# EasyEDA Pro project wukong01-Y003-HTOL.eprj, board PCB1 (continued)
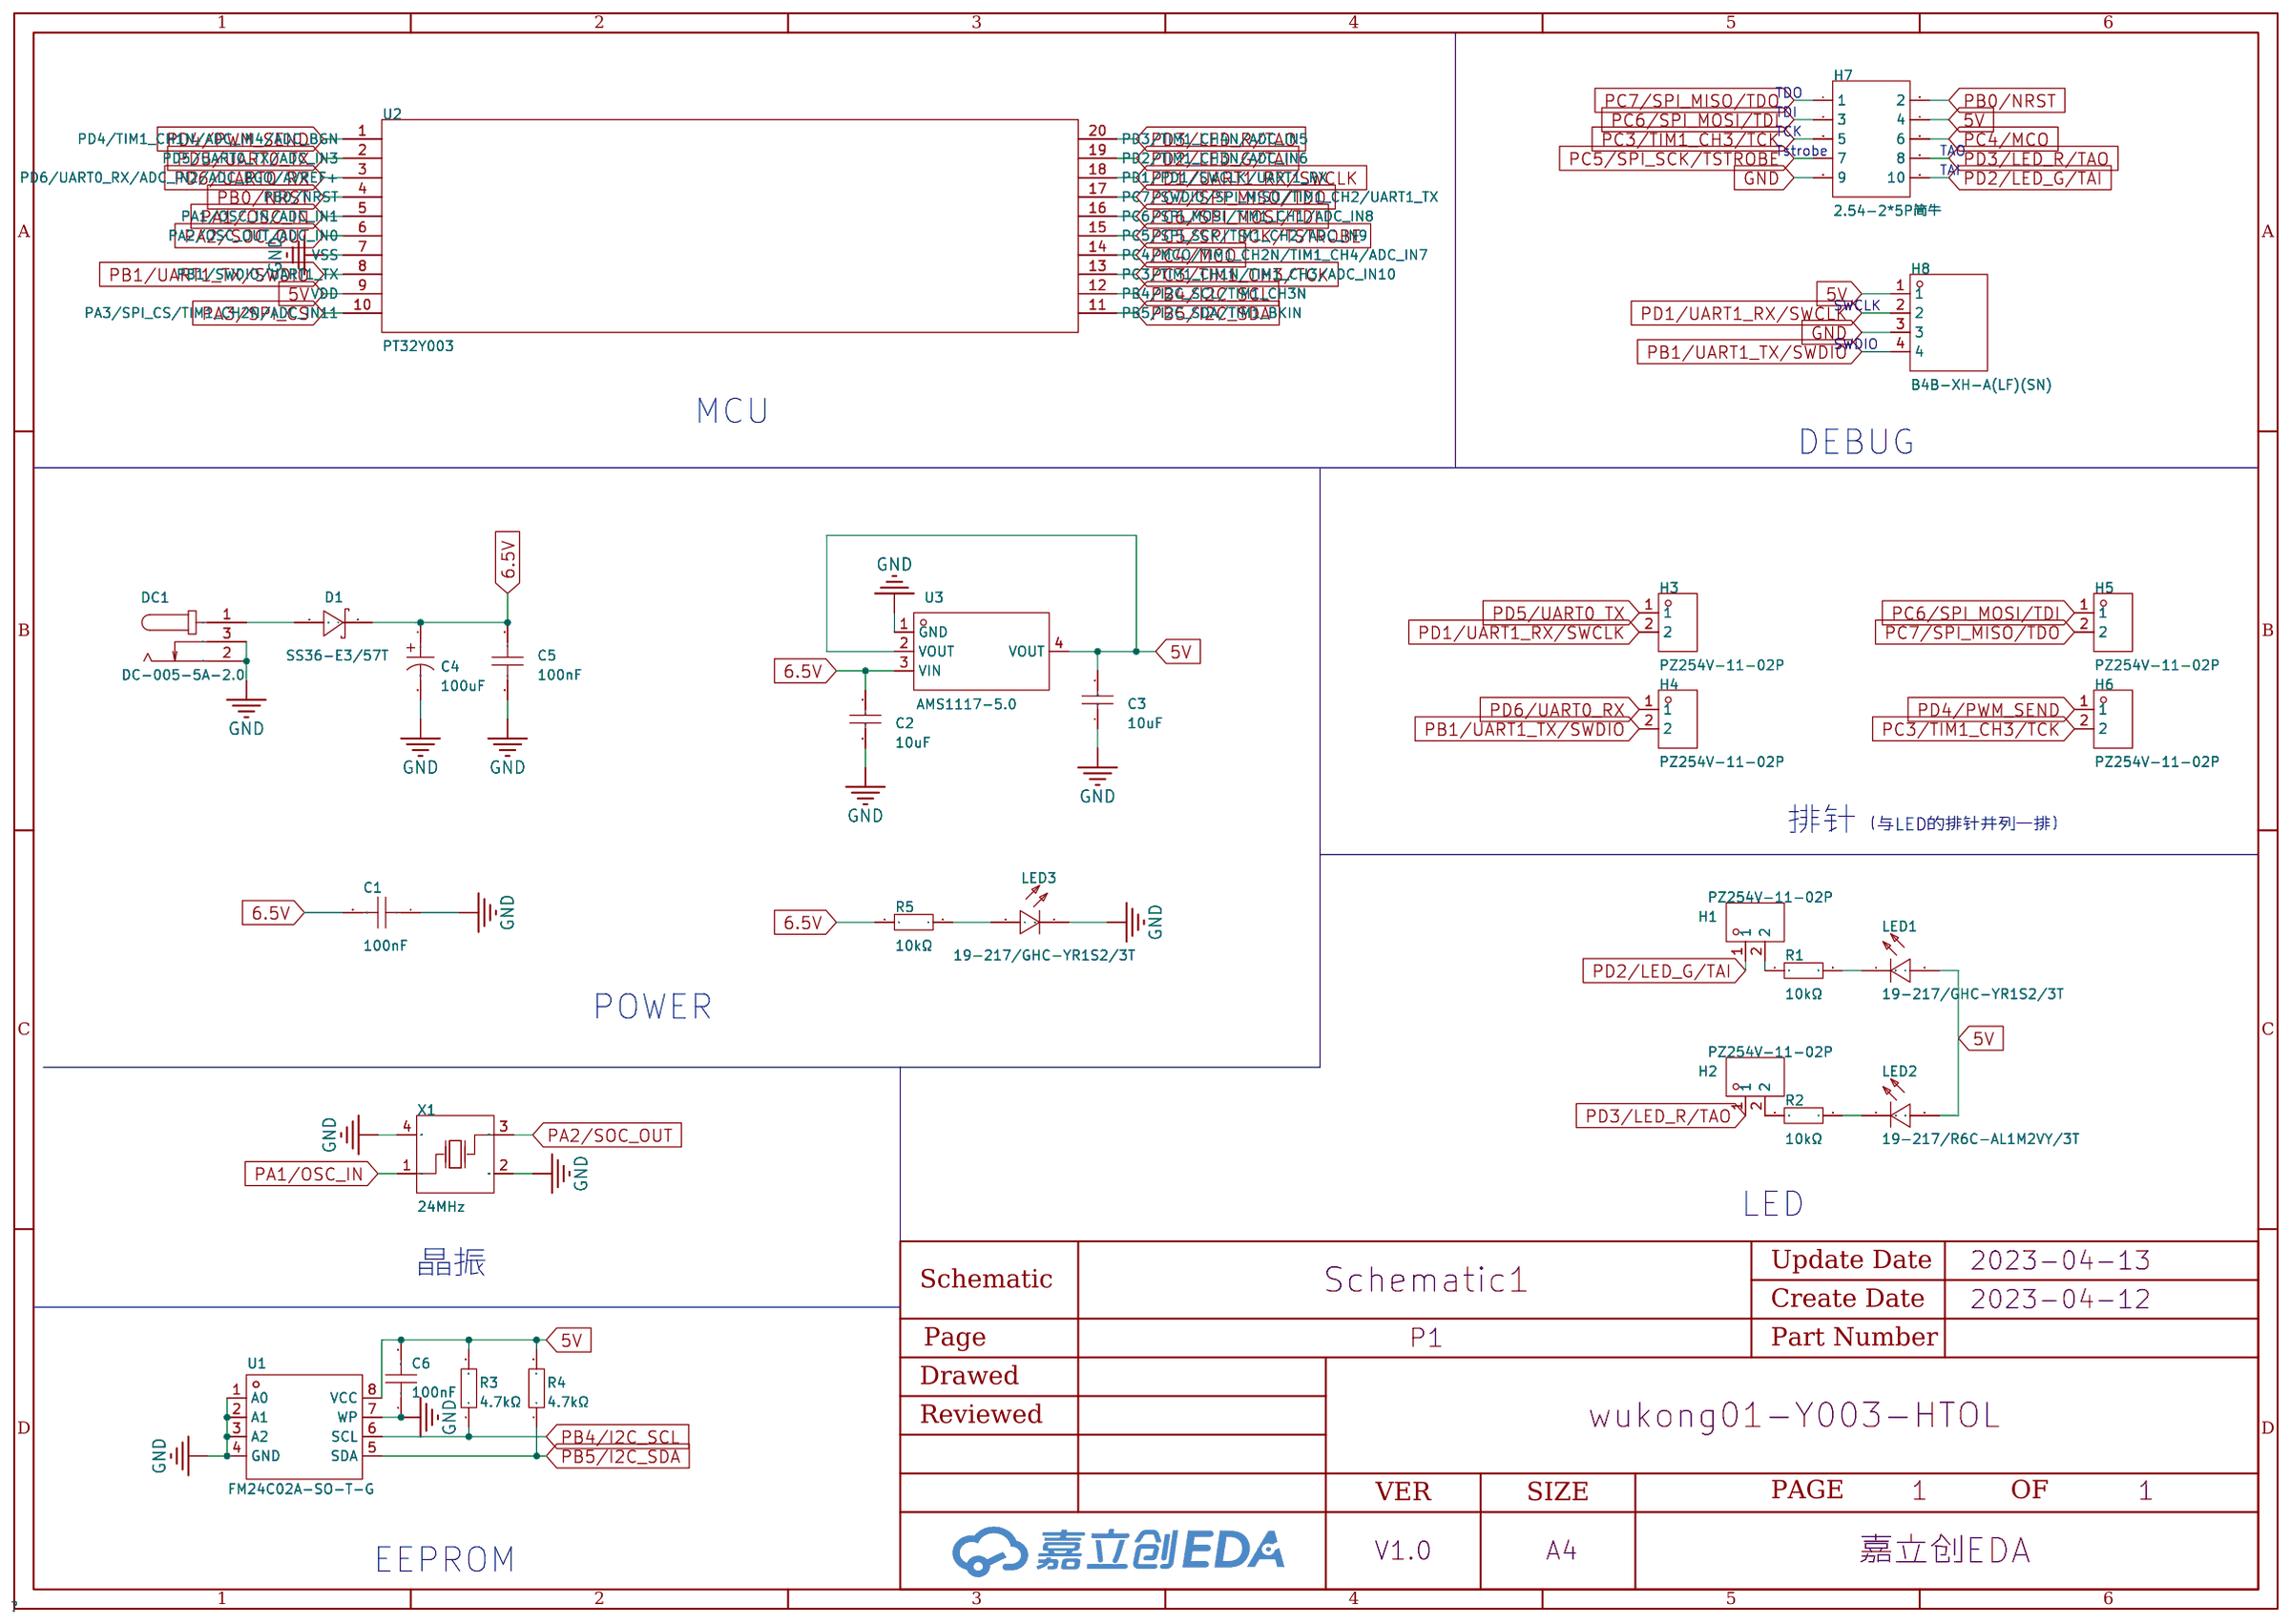
[diagram p0: schematic sheet]
## Routing (per net, layer and track width the routed paths; a pad name or vN(x,y) marks a point on that pad's centre or on a via; arc(x,y) is an arc through that point) (continued)
  Bottom Layer w0.5: v1(257.43,123.7) v1(253.37,123.7) ; H8#7.1 74.3,289.81 76.2,287.91 ; 223.27,244.98 221.36,246.89 H8#27.1 ; v1(208.41,209.55) v1(204.34,209.55) ; 27.18,202.06 25.27,203.96 H8#34.1 ; v1(61.34,80.77) v1(57.28,80.77) ; v1(110.36,209.55) v1(106.3,209.55) ; 223.27,116.21 221.36,118.11 H8#5.1 ; v1(268.85,267.72) v1(268.85,271.02) ; v1(72.76,267.72) v1(72.76,271.02) ; v1(61.34,166.62) v1(57.28,166.62) ; v1(121.78,53.09) v1(121.78,56.39) ; v1(219.83,53.09) v1(219.83,56.39) ; H8#14.1 270.38,75.18 H7#13.4 ; 27.18,159.13 25.27,161.04 H8#40.1 ; H7#32.4 270.38,203.96 H8#32.1 ; v1(72.76,96.01) v1(72.76,99.31) ; 27.18,244.98 25.27,246.89 H8#28.1 ; 223.27,159.13 221.36,161.04 H8#39.1 ; v1(121.78,138.94) v1(121.78,142.24) ; v1(208.41,295.4) v1(204.34,295.4) ; v1(268.85,138.94) v1(268.85,142.24) ; v1(61.34,123.7) v1(57.28,123.7) ; v1(170.81,53.09) v1(170.81,56.39) ; v1(72.76,224.79) v1(72.76,228.09) ; v1(219.83,138.94) v1(219.83,142.24) ; H8#33.1 221.36,203.96 223.27,202.06 ; H7#16.4 172.34,75.18 H8#13.1 ; v1(208.41,123.7) v1(204.34,123.7) ; v1(170.81,138.94) v1(170.81,142.24) ; v1(219.83,96.01) v1(219.83,99.31) ; v1(257.43,252.48) v1(253.37,252.48) ; H8.1 74.3,118.11 76.2,116.21 ; H8#9.1 123.32,289.81 H7#9.4 ; v1(61.34,37.85) v1(57.28,37.85) ; v1(12.32,123.7) v1(8.26,123.7) ; H8#11.1 25.27,75.18 27.18,73.28 ; 27.18,30.35 25.27,32.26 H8#17.1 ; 223.27,287.91 221.36,289.81 H8#15.1 ; 76.2,244.98 74.3,246.89 H8#23.1 ; 76.2,30.35 74.3,32.26 H8#16.1 ; v1(208.41,37.85) v1(204.34,37.85) ; v1(72.76,10.16) v1(72.76,13.46) ; v1(110.36,123.7) v1(106.3,123.7) ; H7#35.4 123.32,161.04 H8#37.1 ; v1(23.74,53.09) v1(23.74,56.39) ; v1(110.36,166.62) v1(106.3,166.62) ; v1(170.81,181.86) v1(170.81,185.17) ; H7.4 123.32,118.11 H8#3.1 ; v1(72.76,181.86) v1(72.76,185.17) ; H8#20.1 123.32,32.26 H7#20.4 ; v1(170.81,96.01) v1(170.81,99.31) ; H7#17.4 123.32,75.18 H8#18.1 ; H8#4.1 270.38,118.11 H7#4.4 ; v1(110.36,252.48) v1(106.3,252.48) ; H8#12.1 74.3,75.18 76.2,73.28 ; H7#25.4 172.34,246.89 H8#24.1 ; 76.2,159.13 74.3,161.04 H8#35.1 ; H8#2.1 172.34,118.11 H7#3.4 ; v1(257.43,80.77) v1(253.37,80.77) ; H8#36.1 172.34,161.04 H7#37.4 ; 223.27,73.28 221.36,75.18 H8#22.1 ; H8#21.1 221.36,32.26 223.27,30.35 ; H8#25.1 123.32,246.89 H7#23.4 ; v1(110.36,295.4) v1(106.3,295.4) ; H8#26.1 270.38,246.89 H7#26.4 ; v1(72.76,53.09) v1(72.76,56.39) ; v1(121.78,96.01) v1(121.78,99.31) ; H8#19.1 172.34,32.26 H7#21.4 ; H7#31.4 172.34,203.96 H8#30.1 ; H8#10.1 270.38,289.81 H7#10.4 ; H7#29.4 123.32,203.96 H8#31.1 ; v1(61.34,295.4) v1(57.28,295.4) ; v1(12.32,80.77) v1(8.26,80.77) ; v1(159.38,252.48) v1(155.32,252.48) ; v1(268.85,181.86) v1(268.85,185.17) ; v1(159.38,80.77) v1(155.32,80.77) ; v1(12.32,166.62) v1(8.26,166.62) ; v1(159.38,295.4) v1(155.32,295.4) ; H8#29.1 74.3,203.96 76.2,202.06 ; v1(268.85,53.09) v1(268.85,56.39) ; v1(219.83,10.16) v1(219.83,13.46) ; v1(121.78,181.86) v1(121.78,185.17) ; v1(23.74,10.16) v1(23.74,13.46) ; v1(208.41,166.62) v1(204.34,166.62) ; v1(170.81,10.16) v1(170.81,13.46) ; v1(23.74,96.01) v1(23.74,99.31) ; v1(268.85,224.79) v1(268.85,228.09) ; v1(208.41,252.48) v1(204.34,252.48) ; H8#6.1 25.27,118.11 27.18,116.21 ; v1(61.34,252.48) v1(57.28,252.48) ; v1(219.83,181.86) v1(219.83,185.17) ; v1(12.32,209.55) v1(8.26,209.55) ; v1(268.85,96.01) v1(268.85,99.31) ; v1(170.81,267.72) v1(170.81,271.02) ; v1(170.81,224.79) v1(170.81,228.09) ; v1(23.74,138.94) v1(23.74,142.24) ; v1(23.74,224.79) v1(23.74,228.09) ; H7#38.4 270.38,161.04 H8#38.1 ; v1(257.43,166.62) v1(253.37,166.62) ; v1(72.76,138.94) v1(72.76,142.24) ; v1(159.38,123.7) v1(155.32,123.7) ; v1(257.43,295.4) v1(253.37,295.4) ; v1(159.38,209.55) v1(155.32,209.55) ; v1(219.83,267.72) v1(219.83,271.02) ; H7#8.4 172.34,289.81 H8#8.1 ; v1(121.78,267.72) v1(121.78,271.02) ; v1(159.38,37.85) v1(155.32,37.85) ; v1(257.43,209.55) v1(253.37,209.55) ; v1(159.38,166.62) v1(155.32,166.62) ; v1(121.78,10.16) v1(121.78,13.46) ; v1(12.32,37.85) v1(8.26,37.85) ; v1(23.74,181.86) v1(23.74,185.17) ; v1(219.83,224.79) v1(219.83,228.09) ; v1(61.34,209.55) v1(57.28,209.55) ; v1(110.36,80.77) v1(106.3,80.77) ; v1(208.41,80.77) v1(204.34,80.77) ; v1(110.36,37.85) v1(106.3,37.85) ; v1(12.32,252.48) v1(8.26,252.48) ; v1(121.78,224.79) v1(121.78,228.09)
6.5V: length 74.3
  Top Layer w0.5: C4.1 19.69,283.85 D1.2 39.67,289.43 U3#4.3 39.81,281.44 35.63,277.25 ; 21.59,274.87 19.77,274.87 17.53,277.11 9,277.11 8.62,276.73 8.62,274.89 ; 21.59,274.87 U3#2.3 ; 21.59,274.87 21.59,276.61 22.24,277.25 35.63,277.25 ; 35.63,277.25 34.76,276.38 U3#3.3
GND: length 6472
  Top Layer w0.4: X1#40.2 159.7,154.65 ; X1#5.2 12.64,111.72 ; X1#29.2 208.72,197.57 ; X1#28.2 159.7,240.5 ; 112.38,24.17 X1#13.4 ; 112.38,110.02 X1#3.4 ; X1#2.2 61.66,111.72 ; X1#39.2 12.64,154.65 ; 14.34,195.87 X1#33.4 ; 210.42,24.17 X1#20.4 ; X1#15.2 159.7,68.8 ; 63.36,152.95 X1#36.4 ; 14.34,152.95 X1#39.4 ; 161.4,110.02 X1#6.4 ; X1#22.2 12.64,25.87 ; X1#33.2 12.64,197.57 ; 259.44,152.95 X1#38.4 ; X1#20.2 208.72,25.87 ; 63.36,24.17 X1#14.4 ; X1#26.2 257.75,240.5 ; 210.42,281.73 X1#12.4 ; 14.34,24.17 X1#22.4 ; 259.44,67.09 259.55,67.09 ; X1#10.2 61.66,68.8 ; X1#8.2 159.7,283.43 ; X1#4.2 257.75,111.72 ; 112.38,152.95 X1#37.4 ; 161.4,152.95 X1#40.4 ; 210.42,152.95 X1#35.4 ; 112.38,238.8 X1#25.4 ; X1#27.2 12.64,240.5 ; 161.4,67.09 161.5,67.09 ; X1#3.2 110.68,111.72 ; X1#31.2 110.68,197.57 ; 259.44,110.02 X1#4.4 ; 259.44,238.8 X1#26.4 ; X1#16.2 257.75,68.8 ; 14.34,238.8 X1#27.4 ; 210.42,195.87 X1#29.4 ; 161.4,24.17 X1#21.4 ; X1#24.2 61.66,240.5 ; X1#30.2 61.66,197.57 ; X1#12.2 208.72,283.43 ; 63.36,281.73 X1#7.4 ; 112.38,195.87 X1#31.4 ; 63.36,195.87 X1#30.4 ; X1#18.2 110.68,68.8 ; X1#37.2 110.68,154.65 ; X1#17.2 12.64,68.8 ; X1#34.2 159.7,197.57 ; 63.36,238.8 X1#24.4 ; 210.42,238.8 X1#23.4 ; X1#9.2 110.68,283.43 ; 161.4,195.87 X1#34.4 ; X1#23.2 208.72,240.5 ; 63.36,110.02 X1#2.4 ; X1.2 208.72,111.72 ; 112.38,67.09 112.48,67.09 ; 259.44,195.87 X1#32.4 ; 63.36,67.09 63.46,67.09 ; X1#19.2 208.72,68.8 ; 161.4,238.8 X1#28.4 ; 210.42,67.09 210.52,67.09 ; X1#14.2 61.66,25.87 ; X1#13.2 110.68,25.87 ; X1#35.2 208.72,154.65 ; X1#21.2 159.7,25.87 ; 210.42,110.02 X1.4 ; 259.44,281.73 X1#11.4 ; 161.4,281.73 X1#8.4 ; X1#25.2 110.68,240.5 ; X1#7.2 61.66,283.43 ; 14.34,67.09 14.44,67.09 ; X1#32.2 257.75,197.57 ; X1#36.2 61.66,154.65 ; 14.34,110.02 X1#5.4 ; X1#11.2 257.75,283.43 ; 112.38,281.73 X1#9.4 ; X1#38.2 257.75,154.65 ; X1#6.2 159.7,111.72
  Top Layer w0.5: 157.37,56.26 U1#17.3 U1#17.4 ; 157.37,56.26 157.5,56.39 U1#17.7 C6#21.1 ; 157.37,56.26 U1#17.2 157.37,57.53 157.35,57.55 157.35,58.97 ; H7#23.9 132.97,242.32 v1(134.75,242.32) ; 108.33,154.65 108.33,168.52 v1(108.34,168.53) 127.51,168.53 128.4,167.64 H8#37.3 ; 108.33,154.65 X1#37.2 ; 108.33,154.65 108.33,144.82 ; v1(134.75,285.24) 132.97,285.24 H7#9.9 ; 255.42,270.89 U1#10.2 255.42,272.16 255.4,272.18 255.4,273.6 ; 255.42,270.89 U1#10.3 U1#10.4 ; 255.42,270.89 255.54,271.02 C6#11.1 ; 108.33,240.5 108.33,254.37 v1(108.34,254.38) 127.51,254.38 128.4,253.49 H8#25.3 ; 108.33,240.5 108.33,230.67 ; 108.33,240.5 X1#25.2 ; U1#11.4 U1#11.3 59.33,56.26 ; v1(134.75,113.54) 132.97,113.54 132.84,113.67 ; 206.38,154.65 206.38,144.82 ; 206.38,154.65 206.38,168.52 v1(206.39,168.53) 225.55,168.53 226.44,167.64 H8#39.3 ; 206.38,154.65 X1#35.2 ; 206.38,144.82 206.38,143.4 206.4,143.38 U1#38.2 206.4,142.11 ; 206.38,144.82 U2#38.7 ; U2#29.7 10.29,230.67 ; 10.29,230.67 10.29,240.5 ; 10.29,230.67 10.29,229.26 10.31,229.24 U1#27.2 10.31,227.97 ; 28.17,278.51 24.88,278.51 ; 28.17,278.51 31.47,278.51 ; 28.17,278.51 28.2,278.54 LED3.1 ; 24.88,278.51 19.69,278.51 C4.2 19.68,278.51 9.14,278.51 8.06,279.59 DC1.3 9.77,298.07 DC1.2 14.78,301.07 21.84,294 39.7,294 U3#4.1 40.88,294.96 C3#4.1 51.18,298.83 v1(54.1,301.75) ; 24.88,278.51 24.89,278.52 C2.2 ; X1#34.2 157.35,197.57 ; 157.35,197.57 157.35,211.44 v1(157.37,211.46) 176.53,211.46 177.42,210.57 H8#30.3 ; 157.35,197.57 157.35,187.75 ; 206.38,25.87 206.38,39.74 v1(206.39,39.75) 225.55,39.75 226.44,38.86 H8#21.3 ; 206.38,25.87 206.38,16.04 ; 206.38,25.87 X1#20.2 ; 59.31,144.82 59.31,143.4 59.33,143.38 U1#35.2 59.33,142.11 ; 59.31,144.82 59.31,154.65 ; 59.31,144.82 U2#39.7 ; U1#14.4 U1#14.3 255.42,56.26 ; 108.33,197.57 108.33,211.44 v1(108.34,211.46) 127.51,211.46 128.4,210.57 H8#31.3 ; 108.33,197.57 X1#31.2 ; 108.33,197.57 108.33,187.75 ; 10.31,13.34 10.44,13.46 U1#12.7 C6#17.1 ; 10.31,13.34 U1#12.3 U1#12.4 ; 10.31,13.34 U1#12.2 10.31,14.61 10.29,14.63 10.29,16.04 ; 108.35,142.11 108.35,143.38 108.33,143.4 108.33,144.82 ; 108.35,142.11 108.35,139.7 ; 108.35,142.11 108.48,142.24 U1#37.7 C6#36.1 ; 108.35,270.89 108.35,268.48 ; 108.35,270.89 108.48,271.02 U1#9.7 C6#10.1 ; 108.35,270.89 108.35,272.16 108.33,272.18 108.33,273.6 ; 83.82,27.81 83.95,27.69 v1(85.72,27.69) ; 206.4,142.11 206.52,142.24 U1#38.7 C6#40.1 ; 206.4,142.11 U1#38.3 U1#38.4 ; 255.4,273.6 U2#13.7 ; 255.4,273.6 255.4,283.43 ; U1#30.4 U1#30.3 255.42,185.04 ; 255.4,187.75 255.4,186.33 255.42,186.31 U1#30.2 255.42,185.04 ; 255.4,187.75 U2#31.7 ; 255.4,187.75 255.4,197.57 ; 59.31,187.75 59.31,186.33 59.33,186.31 U1#29.2 59.33,185.04 ; 59.31,187.75 U2#33.7 ; 59.31,187.75 59.31,197.57 ; X1#15.2 157.35,68.8 ; 157.35,68.8 157.35,58.97 ; 157.35,68.8 157.35,82.67 v1(157.37,82.68) 176.53,82.68 177.42,81.79 H8#13.3 ; 108.33,16.04 108.33,14.63 108.35,14.61 108.35,13.34 ; 108.33,16.04 108.33,25.87 ; 108.33,16.04 U2#18.7 ; 230.89,156.59 231.01,156.46 v1(232.79,156.46) ; v1(232.79,70.61) 231.01,70.61 230.89,70.74 ; H7#8.9 181.99,285.24 v1(183.77,285.24) ; 108.33,273.6 U2#11.7 ; 108.33,273.6 108.33,283.43 ; v1(281.81,242.32) 280.04,242.32 H7#26.9 ; 10.31,99.19 U1#5.3 U1#5.4 ; 10.31,99.19 U1#5.2 10.31,100.46 10.29,100.48 10.29,101.9 ; 10.31,99.19 10.44,99.31 U1#5.7 C6#7.1 ; H8#36.3 177.42,167.64 176.53,168.53 v1(157.37,168.53) 157.35,168.52 157.35,154.65 ; 108.35,99.19 108.35,96.77 ; 108.35,99.19 108.35,100.46 108.33,100.48 108.33,101.9 ; 108.35,99.19 108.48,99.31 U1#3.7 C6#2.1 ; 59.31,25.87 59.31,16.04 ; 59.31,25.87 59.31,39.74 v1(59.32,39.75) 78.49,39.75 79.38,38.86 H8#16.3 ; 59.31,25.87 X1#14.2 ; 59.31,16.04 U2#23.7 ; 59.31,16.04 59.31,14.63 59.33,14.61 U1#16.2 59.33,13.34 ; 157.35,230.67 157.35,229.26 157.37,229.24 U1#28.2 157.37,227.97 ; 157.35,230.67 U2#28.7 ; 157.35,230.67 157.35,240.5 ; 10.31,185.04 U1#33.2 10.31,186.31 10.29,186.33 10.29,187.75 ; 10.31,185.04 U1#33.3 U1#33.4 ; 10.31,185.04 10.44,185.17 U1#33.7 C6#35.1 ; v1(36.7,70.61) 34.92,70.61 34.8,70.74 ; 10.31,227.97 U1#27.3 U1#27.4 ; 10.31,227.97 10.44,228.09 U1#27.7 C6#29.1 ; 255.42,142.11 U1#36.2 255.42,143.38 255.4,143.4 255.4,144.82 ; 255.42,142.11 255.54,142.24 C6#39.1 ; 255.42,142.11 U1#36.3 U1#36.4 ; 255.4,101.9 255.4,100.48 255.42,100.46 U1#2.2 255.42,99.19 ; 255.4,101.9 U2#3.7 ; 255.4,101.9 255.4,111.72 ; v1(183.77,27.69) 181.99,27.69 181.86,27.81 ; 10.29,111.72 10.29,125.59 v1(10.3,125.6) 29.46,125.6 30.35,124.71 H8#6.3 ; 10.29,111.72 X1#5.2 ; 10.29,111.72 10.29,101.9 ; 255.42,56.26 255.54,56.39 C6#15.1 ; 255.42,56.26 U1#14.2 255.42,57.53 255.4,57.55 255.4,58.97 ; U1#16.4 U1#16.3 59.33,13.34 ; 157.37,13.34 U1#20.3 U1#20.4 ; 157.37,13.34 U1#20.2 157.37,14.61 157.35,14.63 157.35,16.04 ; 157.37,13.34 157.5,13.46 U1#20.7 C6#19.1 ; 230.89,242.44 231.01,242.32 v1(232.79,242.32) ; 157.35,240.5 157.35,254.37 v1(157.37,254.38) 176.53,254.38 177.42,253.49 H8#24.3 ; 157.35,240.5 X1#28.2 ; U1#6.4 U1#6.3 157.37,99.19 ; 10.29,240.5 10.29,254.37 v1(10.3,254.38) 29.46,254.38 30.35,253.49 H8#28.3 ; 10.29,240.5 X1#27.2 ; X1#3.2 108.33,111.72 ; 108.33,111.72 108.33,101.9 ; 108.33,111.72 108.33,125.59 v1(108.34,125.6) 127.51,125.6 128.4,124.71 H8#3.3 ; 157.35,25.87 157.35,39.74 v1(157.37,39.75) 176.53,39.75 177.42,38.86 H8#19.3 ; 157.35,25.87 157.35,16.04 ; 157.35,25.87 X1#21.2 ; U1#34.4 U1#34.3 157.37,185.04 ; C6#20.1 U1#16.7 59.46,13.46 59.33,13.34 ; 279.91,156.59 280.04,156.46 v1(281.81,156.46) ; 157.37,227.97 157.5,228.09 U1#28.7 C6#26.1 ; 157.37,227.97 U1#28.3 U1#28.4 ; 157.37,270.89 U1#8.3 U1#8.4 ; 157.37,270.89 157.5,271.02 U1#8.7 C6#9.1 ; 157.37,270.89 U1#8.2 157.37,272.16 157.35,272.18 157.35,273.6 ; 230.89,199.52 231.01,199.39 v1(232.79,199.39) ; X1#17.2 10.29,68.8 ; 10.29,68.8 10.29,82.67 v1(10.3,82.68) 29.46,82.68 30.35,81.79 H8#11.3 ; 10.29,68.8 10.29,58.97 ; 108.35,185.04 108.48,185.17 U1#31.7 C6#30.1 ; 108.35,185.04 108.35,182.63 ; 108.35,185.04 108.35,186.31 108.33,186.33 108.33,187.75 ; 10.31,56.26 U1#22.2 10.31,57.53 10.29,57.55 10.29,58.97 ; 10.31,56.26 U1#22.3 U1#22.4 ; 10.31,56.26 10.44,56.39 U1#22.7 C6#16.1 ; 108.35,13.34 108.35,10.92 ; 108.35,13.34 108.48,13.46 U1#21.7 C6#14.1 ; 206.38,16.04 206.38,14.63 206.4,14.61 U1#19.2 206.4,13.34 ; 206.38,16.04 U2#21.7 ; v1(85.72,70.61) 83.95,70.61 H7#15.9 ; C6#37.1 U1#35.7 59.46,142.24 59.33,142.11 ; 157.35,154.65 157.35,144.82 ; 157.35,154.65 X1#40.2 ; C6#4.1 U1#6.7 157.5,99.31 157.37,99.19 ; U1#24.4 U1#24.3 255.42,227.97 ; v1(134.75,156.46) 132.97,156.46 132.84,156.59 ; 59.33,270.89 U1#7.3 U1#7.4 ; 59.33,270.89 59.46,271.02 U1#7.7 C6#8.1 ; 59.33,270.89 U1#7.2 59.33,272.16 59.31,272.18 59.31,273.6 ; v1(281.81,70.61) 280.04,70.61 H7#13.9 ; v1(281.81,199.39) 280.04,199.39 H7#32.9 ; v1(183.77,242.32) 181.99,242.32 H7#25.9 ; X1#33.2 10.29,197.57 ; 10.29,197.57 10.29,211.44 v1(10.3,211.46) 29.46,211.46 30.35,210.57 H8#34.3 ; 10.29,197.57 10.29,187.75 ; X1#10.2 59.31,68.8 ; 59.31,68.8 59.31,82.67 v1(59.32,82.68) 78.49,82.68 79.38,81.79 H8#12.3 ; 59.31,68.8 59.31,58.97 ; 255.42,227.97 255.54,228.09 C6#27.1 ; 255.42,227.97 U1#24.2 255.42,229.24 255.4,229.26 255.4,230.67 ; 10.29,144.82 10.29,143.4 10.31,143.38 U1#39.2 10.31,142.11 ; 10.29,144.82 U2.7 ; 10.29,144.82 10.29,154.65 ; U1#4.4 U1#4.3 206.4,99.19 ; H8#20.3 128.4,38.86 127.51,39.75 v1(108.34,39.75) 108.33,39.74 108.33,25.87 ; 230.89,285.37 231.01,285.24 v1(232.79,285.24) ; 206.38,58.97 206.38,57.55 206.4,57.53 U1#15.2 206.4,56.26 ; 206.38,58.97 U2#19.7 ; 206.38,58.97 206.38,68.8 ; U2#12.7 255.4,58.97 ; 255.4,58.97 255.4,68.8 ; 108.33,68.8 108.33,58.97 ; 108.33,68.8 X1#18.2 ; 108.33,68.8 108.33,82.67 v1(108.34,82.68) 127.51,82.68 128.4,81.79 H8#18.3 ; 108.33,58.97 U2#15.7 ; 108.33,58.97 108.33,57.55 108.35,57.53 108.35,56.26 ; v1(183.77,199.39) 181.99,199.39 H7#31.9 ; C6#23.1 U1#15.7 206.52,56.39 206.4,56.26 ; 34.8,242.44 34.92,242.32 v1(36.7,242.32) ; U1#19.4 U1#19.3 206.4,13.34 ; 157.35,58.97 U2#7.7 ; 59.31,154.65 59.31,168.52 v1(59.32,168.53) 78.49,168.53 79.38,167.64 H8#35.3 ; 59.31,154.65 X1#36.2 ; 255.42,99.19 U1#2.3 U1#2.4 ; 255.42,99.19 255.54,99.31 C6#5.1 ; X1#13.2 108.33,25.87 ; 108.33,187.75 U2#30.7 ; 206.4,99.19 U1#4.2 206.4,100.46 206.38,100.48 206.38,101.9 ; 206.4,99.19 206.52,99.31 U1#4.7 C6#6.1 ; v1(36.7,113.54) 34.92,113.54 34.8,113.67 ; 59.33,99.19 59.46,99.31 U1.7 C6#3.1 ; 59.33,99.19 U1.3 U1.4 ; 59.33,99.19 U1.2 59.33,100.46 59.31,100.48 59.31,101.9 ; U1#29.4 U1#29.3 59.33,185.04 ; H8#2.3 177.42,124.71 176.53,125.6 v1(157.37,125.6) 157.35,125.59 157.35,111.72 ; U2#32.7 206.38,187.75 ; 206.38,187.75 206.38,197.57 ; 206.38,187.75 206.38,186.33 206.4,186.31 U1#32.2 206.4,185.04 ; 206.4,270.89 U1#13.2 206.4,272.16 206.38,272.18 206.38,273.6 ; 206.4,270.89 U1#13.3 U1#13.4 ; 206.4,270.89 206.52,271.02 U1#13.7 C6#12.1 ; v1(281.81,113.54) 280.04,113.54 279.91,113.67 ; X1#23.2 206.38,240.5 ; 206.38,240.5 206.38,230.67 ; 206.38,240.5 206.38,254.37 v1(206.39,254.38) 225.55,254.38 226.44,253.49 H8#27.3 ; C6#38.1 U1#40.7 157.5,142.24 157.37,142.11 ; v1(36.7,27.69) 34.92,27.69 34.8,27.81 ; 10.31,142.11 U1#39.3 U1#39.4 ; 10.31,142.11 10.44,142.24 U1#39.7 C6.1 ; 206.38,111.72 206.38,101.9 ; 206.38,111.72 206.38,125.59 v1(206.39,125.6) 225.55,125.6 226.44,124.71 H8#5.3 ; 206.38,111.72 X1.2 ; 206.38,101.9 U2#4.7 ; 206.4,13.34 206.52,13.46 U1#19.7 C6#22.1 ; H7#30.9 83.95,199.39 v1(85.72,199.39) ; 10.29,101.9 U2#8.7 ; 108.35,56.26 108.35,53.85 ; 108.35,56.26 108.48,56.39 U1#18.7 C6#13.1 ; X1#4.2 255.4,111.72 ; 255.4,111.72 255.4,125.59 v1(255.41,125.6) 274.57,125.6 275.46,124.71 H8#4.3 ; 157.35,144.82 157.35,143.4 157.37,143.38 U1#40.2 157.37,142.11 ; 157.35,144.82 U2#40.7 ; 255.4,68.8 255.4,82.67 v1(255.41,82.68) 274.57,82.68 275.46,81.79 H8#14.3 ; 255.4,68.8 X1#16.2 ; H7#10.9 280.04,285.24 v1(281.81,285.24) ; 255.42,185.04 255.54,185.17 C6#33.1 ; C6#31.1 U1#29.7 59.46,185.17 59.33,185.04 ; 206.38,68.8 206.38,82.67 v1(206.39,82.68) 225.55,82.68 226.44,81.79 H8#22.3 ; 206.38,68.8 X1#19.2 ; v1(183.77,156.46) 181.99,156.46 181.86,156.59 ; 10.29,16.04 U2#22.7 ; 10.29,16.04 10.29,25.87 ; 59.31,240.5 59.31,230.67 ; 59.31,240.5 X1#24.2 ; 59.31,240.5 59.31,254.37 v1(59.32,254.38) 78.49,254.38 79.38,253.49 H8#23.3 ; 59.31,230.67 59.31,229.26 59.33,229.24 U1#23.2 59.33,227.97 ; 59.31,230.67 U2#27.7 ; U1#32.4 U1#32.3 206.4,185.04 ; X1#9.2 108.33,283.43 ; 108.33,283.43 108.33,297.3 v1(108.34,297.31) 127.51,297.31 128.4,296.42 H8#9.3 ; 157.35,101.9 157.35,100.48 157.37,100.46 U1#6.2 157.37,99.19 ; 157.35,101.9 157.35,111.72 ; 157.35,101.9 U2#6.7 ; v1(183.77,113.54) 181.99,113.54 181.86,113.67 ; 34.8,156.59 34.92,156.46 v1(36.7,156.46) ; 34.8,199.52 34.92,199.39 v1(36.7,199.39) ; 206.4,185.04 206.52,185.17 U1#32.7 C6#34.1 ; 157.35,283.43 157.35,297.3 v1(157.37,297.31) 176.53,297.31 177.42,296.42 H8#8.3 ; 157.35,283.43 157.35,273.6 ; 157.35,283.43 X1#8.2 ; v1(39.12,263.27) 39.24,263.27 40.39,264.41 40.39,265.76 C3#3.1 40.38,273.84 U3#3.1 ; H7#24.9 83.95,242.32 v1(85.72,242.32) ; v1(183.77,70.61) 181.99,70.61 H7#16.9 ; C1.1 35.05,278.51 31.47,278.51 ; v1(27.3,263.27) 27.3,265.65 C3#2.1 27.19,273.84 U3#2.1 ; 59.33,56.26 U1#11.2 59.33,57.53 59.31,57.55 59.31,58.97 ; 59.33,56.26 59.46,56.39 U1#11.7 C6#18.1 ; 31.47,278.51 31.5,278.54 31.5,287.97 ; v1(134.75,70.61) 132.97,70.61 H7#17.9 ; U2#25.7 255.4,230.67 ; 255.4,230.67 255.4,240.5 ; 157.35,273.6 U2#10.7 ; H8.3 79.38,124.71 78.49,125.6 v1(59.32,125.6) 59.31,125.59 59.31,111.72 ; X1#6.2 157.35,111.72 ; X1#38.2 255.4,154.65 ; 255.4,154.65 255.4,144.82 ; 255.4,154.65 255.4,168.52 v1(255.41,168.53) 274.57,168.53 275.46,167.64 H8#38.3 ; X1#7.2 59.31,283.43 ; 59.31,283.43 59.31,273.6 ; 59.31,283.43 59.31,297.3 v1(59.32,297.31) 78.49,297.31 79.38,296.42 H8#7.3 ; 206.4,227.97 U1#26.2 206.4,229.24 206.38,229.26 206.38,230.67 ; 206.4,227.97 206.52,228.09 U1#26.7 C6#28.1 ; 206.4,227.97 U1#26.3 U1#26.4 ; 108.33,144.82 U2#36.7 ; C6#25.1 U1#23.7 59.46,228.09 59.33,227.97 ; 255.4,144.82 U2#37.7 ; 59.33,142.11 U1#35.3 U1#35.4 ; v1(134.75,27.69) 132.97,27.69 132.84,27.81 ; 206.4,56.26 U1#15.3 U1#15.4 ; 108.33,101.9 U2#2.7 ; U3.1 14.23,273.88 C3.1 14.23,264.28 15.24,263.27 v1(21.34,263.27) ; 206.38,283.43 206.38,273.6 ; 206.38,283.43 206.38,297.3 v1(206.39,297.31) 225.55,297.31 226.44,296.42 H8#15.3 ; 206.38,283.43 X1#12.2 ; 206.38,273.6 U2#16.7 ; 157.35,16.04 U2#17.7 ; X1#11.2 255.4,283.43 ; 255.4,283.43 255.4,297.3 v1(255.41,297.31) 274.57,297.31 275.46,296.42 H8#10.3 ; 10.29,25.87 X1#22.2 ; 10.29,25.87 10.29,39.74 v1(10.3,39.75) 29.46,39.75 30.35,38.86 H8#17.3 ; 10.29,154.65 10.29,168.52 v1(10.3,168.53) 29.46,168.53 30.35,167.64 H8#40.3 ; 10.29,154.65 X1#39.2 ; 157.35,187.75 157.35,186.33 157.37,186.31 U1#34.2 157.37,185.04 ; 157.35,187.75 U2#34.7 ; 206.38,230.67 U2#26.7 ; 59.31,101.9 59.31,111.72 ; 59.31,101.9 U2#5.7 ; 59.33,227.97 U1#23.3 U1#23.4 ; 59.31,111.72 X1#2.2 ; 10.29,187.75 U2#35.7 ; 108.33,230.67 108.33,229.26 108.35,229.24 108.35,227.97 ; 108.33,230.67 U2#24.7 ; 59.31,273.6 U2#9.7 ; v1(85.72,156.46) 83.95,156.46 83.82,156.59 ; 157.37,142.11 U1#40.3 U1#40.4 ; 108.35,227.97 108.35,225.55 ; 108.35,227.97 108.48,228.09 U1#25.7 C6#24.1 ; C6#32.1 U1#34.7 157.5,185.17 157.37,185.04 ; 10.29,58.97 U2#20.7 ; H8#29.3 79.38,210.57 78.49,211.46 v1(59.32,211.46) 59.31,211.44 59.31,197.57 ; 206.38,197.57 206.38,211.44 v1(206.39,211.46) 225.55,211.46 226.44,210.57 H8#33.3 ; 206.38,197.57 X1#29.2 ; U2#14.7 59.31,58.97 ; 83.82,113.67 83.95,113.54 v1(85.72,113.54) ; v1(134.75,199.39) 132.97,199.39 H7#29.9 ; 59.31,197.57 X1#30.2 ; 230.89,113.67 231.01,113.54 v1(232.79,113.54) ; 255.4,197.57 X1#32.2 ; 255.4,197.57 255.4,211.44 v1(255.41,211.46) 274.57,211.46 275.46,210.57 H8#32.3 ; v1(232.79,27.69) 231.01,27.69 230.89,27.81 ; 255.4,240.5 255.4,254.37 v1(255.41,254.38) 274.57,254.38 275.46,253.49 H8#26.3 ; 255.4,240.5 X1#26.2 ; H7#7.9 83.95,285.24 v1(85.72,285.24)